# EasyEDA Pro project Q's HelloWorld KeyBoard.eprj, schematic SCH旋钮主控板
Create Date: 2022-10-09; Page Name: P1; Project Name: Q's HelloWorld KeyBoard; Schematic Name: SCH旋钮主控板; Update Date: 2022-10-15; Company: 嘉立创EDA; Page Size: A3; Version: V1.0
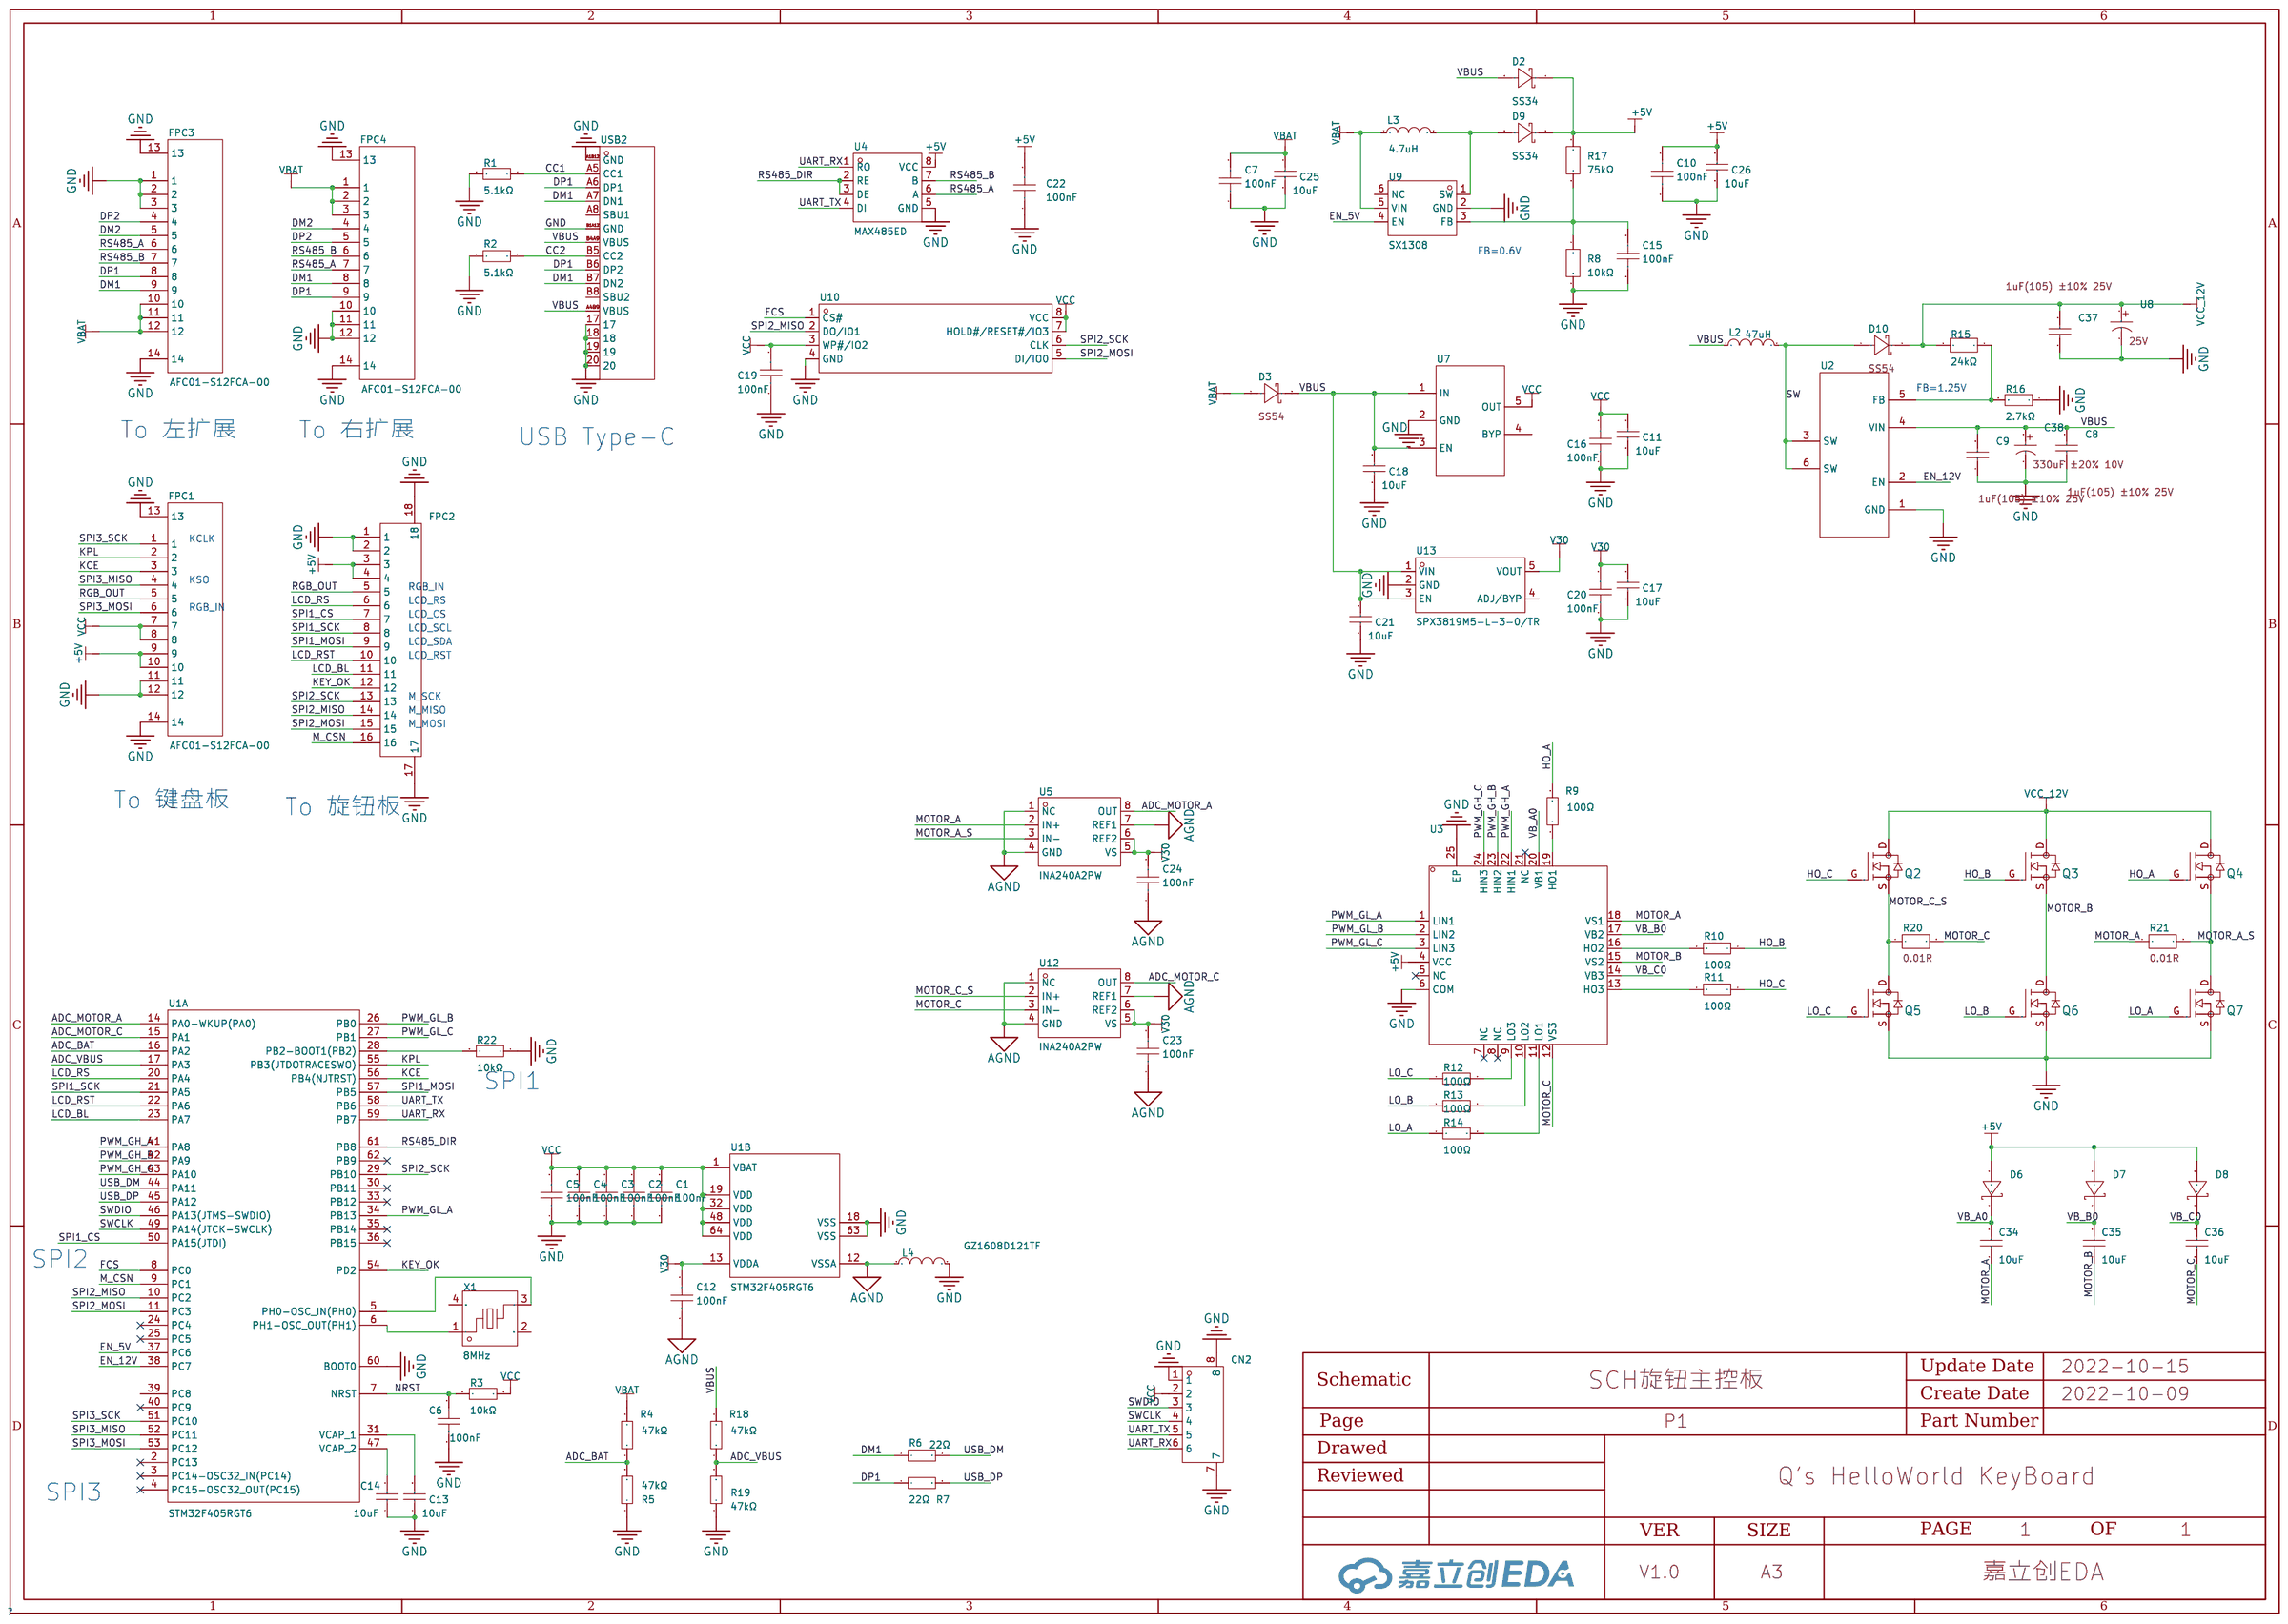
[diagram p8: schematic sheet]

## Parts
C1  100nF  [C0402]
C2  100nF  [C0402]
C3  100nF  [C0402]
C4  100nF  [C0402]
C5  100nF  [C0402]
C6  100nF  [C0402]
C7  100nF  [C0402]
C8  1uF  [C0402]
C9  1uF  [C0402]
C10  100nF  [C0402]
C11  10uF  [C0402]
C12  100nF  [C0402]
C13  10uF  [C0402]
C14  10uF  [C0402]
C15  100nF  [C0402]
C16  100nF  [C0402]
C17  10uF  [C0402]
C18  10uF  [C0402]
C19  100nF  [C0402]
C20  100nF  [C0402]
C21  10uF  [C0402]
C22  100nF  [C0402]
C23  100nF  [C0402]
C24  100nF  [C0402]
C25  10uF  [C0402]
C26  10uF  [C0402]
C34  10uF  [C0402]
C35  10uF  [C0402]
C36  10uF  [C0402]
C37  1uF  [C0402]
C38  330uF  [CAP-TH_BD6.3-P2.50-D1.0-FD]
CN2  1.0K-BH-6PWB  [CONN-SMD_6P-P1.00_HDGC_1.0K-BH-6PWB]
D2  SS34  [SMA_L4.3-W2.6-LS5.2-RD]
D3  SS54  [SMC_L7.1-W6.2-LS8.1-R-RD]
D6  -  [SOD-323_L1.8-W1.3-LS2.5-RD]
D7  -  [SOD-323_L1.8-W1.3-LS2.5-RD]
D8  -  [SOD-323_L1.8-W1.3-LS2.5-RD]
D9  SS34  [SMA_L4.3-W2.6-LS5.2-RD]
D10  SS54  [SMC_L7.1-W6.2-LS8.1-R-RD]
FPC1  AFC01-S12FCA-00  [FPC-SMD_AFC01-S12FCA-00]
FPC2  AFC01-S16FCA-00  [FPC-SMD_P0.50-16P_FGS-XJ-H2.0]
FPC3  AFC01-S12FCA-00  [FPC-SMD_AFC01-S12FCA-00]
FPC4  AFC01-S12FCA-00  [FPC-SMD_AFC01-S12FCA-00]
L2  47uH  [IND-SMD_L11.5-W10.0]
L3  4.7uH  [IND-SMD_L5.8-W5.2]
L4  GZ1608D121TF  [L0603]
Q2  EMB09N03V  [DFN3x3]
Q3  EMB09N03V  [DFN3x3]
Q4  EMB09N03V  [DFN3x3]
Q5  EMB09N03V  [DFN3x3]
Q6  EMB09N03V  [DFN3x3]
Q7  EMB09N03V  [DFN3x3]
R1  5.1kΩ  [R0402]
R2  5.1kΩ  [R0402]
R3  10kΩ  [R0402]
R4  47kΩ  [R0402]
R5  47kΩ  [R0402]
R6  22Ω  [R0402]
R7  22Ω  [R0402]
R8  10kΩ  [R0402]
R9  100Ω  [R0402]
R10  100Ω  [R0402]
R11  100Ω  [R0402]
R12  100Ω  [R0402]
R13  100Ω  [R0402]
R14  100Ω  [R0402]
R15  24kΩ  [R0402]
R16  2.7kΩ  [R0402]
R17  75kΩ  [R0402]
R18  47kΩ  [R0402]
R19  47kΩ  [R0402]
R20  ERJ14YJ205U  [R1210]
R21  ERJ14YJ205U  [R1210]
R22  10kΩ  [R0402]
U1  STM32F405RGT6  [LQFP-64_L10.0-W10.0-P0.50-LS12.0-BL]  (sections 1,2)
U2  -  [TO-263-5_L10.2-W9.9-P1.70-LS14.4-TL]
U3  -  [QFN-24_L4.0-W4.0-P0.50-BL-EP2.6]
U4  MAX485ED  [SOP-8_L4.9-W3.9-P1.27-LS6.0-BL]
U5  INA240A2PW  [TSSOP-8_L4.4-W3.0-P0.65-LS6.4-BR]
U7  -  [SOT-23-5_L3.0-W1.7-P0.95-LS2.8-BR]
U8  UHE1J471MHDFZXCV  [CAP-TH_BD12.5-P5.00-D0.6-FD]
U9  SX1308  [SOT-23-6_L2.9-W1.6-P0.95-LS2.8-BR]
U10  W25Q16JVSNIQ  [SOIC-8_L5.2-W5.2-P1.27-LS7.9-BL]
U12  INA240A2PW  [TSSOP-8_L4.4-W3.0-P0.65-LS6.4-BR]
U13  SPX3819M5-L-3-0/TR  [SOT-23-5_L2.9-W1.6-P0.95-LS2.8-TL]
USB2  TYPE-C-2.0-16PIN-SMT-3-OR  [USB-SMD_TYPE-C16PIN-1]
X1  8MHz  [OSC-SMD_4P-L3.2-W2.5-BL]

## Library data of the parts
C1-C7 C10 C12 C15 C16 C19 C20 C22-C24 = GCM155R71C104KA55J: 容值:100nF;精度:±10%;额定电压:-;材质(温度系数):-;; LCSC Part Name: 100nF ±10%; Supplier Part: C2655418; Manufacturer: muRata(村田); Supplier Footprint: 0402; JLCPCB Part Class: Extended Part; Datasheet: https://atta.szlcsc.com/upload/public/pdf/source/20210701/42090801FDE37D0E45AFF657247F4A08.pdf; Supplier: LCSC; Tolerance: ±10%
C8 C9 C37 = GRM155R61E105KA12D: 温度系数:X5R;额定电压:25V;精度:±10%;容值:1uF;; LCSC Part Name: 1uF(105) ±10% 25V; Supplier Part: C77009; Manufacturer: muRata(村田); Supplier Footprint: 0402; JLCPCB Part Class: Extended Part; Datasheet: https://atta.szlcsc.com/upload/public/pdf/source/20180326/C77009_C84F63FC30571BAC77C5C818267378FE.pdf; Supplier: LCSC; Temperature Coefficient: X5R; Voltage Rated: 25V; Tolerance: ±10%
C11 C13 C14 C17 C18 C21 C25 C26 = CL05A106MQ5NUNC: 容值:10uF;精度:±20%;额定电压:6.3V;材质(温度系数):X5R;; LCSC Part Name: 10uF ±20% 6.3V; Supplier Part: C15525; Manufacturer: SAMSUNG(三星); Supplier Footprint: 0402; JLCPCB Part Class: Basic Part; Datasheet: https://atta.szlcsc.com/upload/public/pdf/source/20220823/2B02EE04F8F211D38A52DCB16EB6BEBA.pdf; Supplier: LCSC; Tolerance: ±20%; Voltage Rated: 6.3V; Temperature Coefficient: X5R
C34-C36 = CC0402MRX5R5BB106: 容值:10uF;精度:±20%;额定电压:10V;温度系数:X5R;; LCSC Part Name: 10uF ±20% 10V; Supplier Part: C105884; Manufacturer: YAGEO(国巨); Supplier Footprint: 0402; Datasheet: https://atta.szlcsc.com/upload/public/pdf/source/20170728/C105884_1501225684064848716.pdf; Supplier: LCSC; Tolerance: ±20%; Voltage Rated: 10V; Temperature Coefficient: X5R
C38 = 10PX330MEFC6.3X11: 容值:330uF;精度:±20%;额定电压:10V;电容体直径:6.3mm;电容体长度:11mm;脚间距:2.5mm;纹波电流:282mA@10kHz;等效串联电阻:-;工作寿命:1000hrs@105;; LCSC Part Name: 330uF ±20% 10V; Supplier Part: C88841; Manufacturer: rubycon(红宝石); Supplier Footprint: 径向引线,6.3x11mm; JLCPCB Part Class: Extended Part; Datasheet: https://atta.szlcsc.com/upload/public/pdf/source/20161125/1480067908543.pdf; Supplier: LCSC; Tolerance: ±20%; Rated Voltage: 10V; φD: 6.3mm; L: 11mm; Lead Spacing: 2.5mm; Ripple Current: 282mA@10kHz; Lifetime @ Temp: 1000hrs@105
CN2 = 1.0K-BH-6PWB: 参考系列:-;间距:1mm;插针结构:1x6P;排数:1;每排PIN数:6;行距:-;公母:公型插针;安装方式:卧贴;额定电流:-;工作温度范围:-25~+85;; LCSC Part Name: 1x6P 间距P=1.0mm 卧贴 SMT; Supplier Part: C2919607; Manufacturer: HDGC(华德共创); Supplier Footprint: SMD,P=1mm; JLCPCB Part Class: Extended Part; Datasheet: https://atta.szlcsc.com/upload/public/pdf/source/20211115/0C4A9B301513FDEAA34F959002791CED.pdf; Supplier: LCSC; Pitch: 1mm; Pins Structure: 1x6P; Number of Rows: 1; Number of PINs Per Row: 6; Gender: 公型插针; Mounting Style: 卧贴; Operating Temperature Range: -25~+85
D2 D9 = SS34_C3032484: Supplier Part: C3032484; Manufacturer: TDD(台冠电子); Supplier Footprint: SMA; JLCPCB Part Class: Extended Part; Datasheet: https://atta.szlcsc.com/upload/public/pdf/source/20220622/9D70D0693761B542BF6F533590093AA5.pdf; Supplier: LCSC
D3 D10 = SS54_C211777: 二极管配置:独立式;直流反向耐压(Vr):40V;平均整流电流(Io):5A;正向压降(Vf):600mV@5A;反向电流(Ir):200A@40V;; LCSC Part Name: 40V 5A 600mV@5A; Supplier Part: C211777; Manufacturer: YANGJIE(扬杰); Supplier Footprint: SMC; JLCPCB Part Class: Extended Part; Datasheet: https://atta.szlcsc.com/upload/public/pdf/source/20200709/C698823_E961B659E8FF1C386B21C65769F2CB60.pdf; Supplier: LCSC; Diode Configuration: 独立式; Reverse Voltage (Vr): 40V; Average Rectified Current (Io): 5A; Forward Voltage (Vf@If): 600mV@5A; Reverse Leakage Current (Ir): 200A@40V
D6-D8 = B5819WS: 直流反向耐压(Vr):40V;平均整流电流(Io):1A;正向压降(Vf):900mV@3A;; LCSC Part Name: 40V 1A 900mV@3A; Supplier Part: C488405; Manufacturer: Slkor(萨科微); Supplier Footprint: SOD-323; Datasheet: https://atta.szlcsc.com/upload/public/pdf/source/20200225/C488405_E29BA61770FF7744B37A87F1ECFA4444.pdf; Supplier: LCSC; Reverse Voltage (Vr): 40V; Average Rectified Current (Io): 1A; Forward Voltage (Vf@If): 900mV@3A
FPC1 FPC3 FPC4 = AFC01-S12FCA-00: 间距:0.5mm;触点数量:12;锁定特性:翻盖式;安装类型:卧贴;触点类型:下接;; LCSC Part Name: 0.5mm P数:12 翻盖式 下接; Supplier Part: C262661; Manufacturer: JS(钜硕电子); Supplier Footprint: SMD,P=0.5mm; JLCPCB Part Class: Extended Part; Datasheet: https://atta.szlcsc.com/upload/public/pdf/source/20180810/C262661_216573474FA4FCB7E7D6D6C5859A7896.pdf; Supplier: LCSC; Pitch: 0.5mm; Number of Contacts: 12; Locking Feature: 翻盖式; Mounting Type: 卧贴; Contact Type: 下接; Height Above Board: 2mm; FFC, FCB Thickness: 0.3mm
FPC2 = AFC01-S16FCA-00: 间距:0.5mm;触点数量:16;锁定特性:翻盖式;安装类型:卧贴;触点类型:下接;; LCSC Part Name: 0.5mm P数:16 翻盖式 下接; Supplier Part: C262665; Manufacturer: JS(钜硕电子); Supplier Footprint: SMD,P=0.5mm; JLCPCB Part Class: Extended Part; Datasheet: https://atta.szlcsc.com/upload/public/pdf/source/20180814/C262665_DC336C287B4B4904E7F77F7A745F9142.pdf; Supplier: LCSC; Pitch: 0.5mm; Number of Contacts: 16; Locking Feature: 翻盖式; Mounting Type: 卧贴; Contact Type: 下接; Height Above Board: 2mm; FFC, FCB Thickness: 0.3mm
L2 = MS1040-330M: 电感值:33uH;精度:±20%;额定电流:3.5A;直流电阻(DCR):85mΩ;; LCSC Part Name: 33uH ±20% 3.5A 85mΩ; Supplier Part: C380056; Manufacturer: COILMX(迈翔科技); Supplier Footprint: SMD; JLCPCB Part Class: Extended Part; Datasheet: https://atta.szlcsc.com/upload/public/pdf/source/20190429/C380056_8E35FDD148AEC95757B8FF4D95CD7513.pdf; Supplier: LCSC; Tolerance: ±20%; Rated Current: 3.5A; DC Resistance (DCR): 85mΩ
L3 = CD54-4R7M-T-Z: 电感值:4.7uH;精度:±20%;额定电流:-;直流电阻(DCR):-;; LCSC Part Name: 4.7uH ±20%; Supplier Part: C501775; Manufacturer: Me-TECH(美台高科); Supplier Footprint: SMD; JLCPCB Part Class: Extended Part; Datasheet: https://atta.szlcsc.com/upload/public/pdf/source/20200324/C501728_0ED92A661C9AA91DB0CB8AF3A2A8117A.pdf; Supplier: LCSC; Tolerance: ±20%
L4 = GZ1608D121TF_C12391: 标称阻抗@测试频率:120Ω@100MHz;误差:±25%;直流电阻(RDC):200mΩ;额定电流:300mA;电路数:1;; LCSC Part Name: 120Ω@100MHz ±25%; Supplier Part: C12391; Manufacturer: Sunlord(顺络); Supplier Footprint: 0603; JLCPCB Part Class: Extended Part; Datasheet: https://atta.szlcsc.com/upload/public/pdf/source/20210830/355EA7C0FAC5394FC0FE3F17C770C20A.pdf; Supplier: LCSC; Impedance @ Frequency: 120Ω@100MHz; Tolerance: ±25%; DC Resistance: 200mΩ; Current Rating: 300mA; Circuits: 1
Q2-Q7 = EMB09N03V: MOSFET N-CH 30V 10A; Category: Discrete Semiconductor Products; Operating Temperature: -55°C ~ 175°C (TJ); Stock: 1490; FET Type: N-Channel; Manufacturer: ON Semiconductor; Manufacturer Part Number: NTMFS5C628NLT1G; Gate Charge (Qg) (Max) @ Vgs: 52nC @ 10V; Input Capacitance (Ciss) (Max) @ Vds: 3600pF @ 25V; Power Dissipation (Max): 3.7W (Ta), 110W (Tc); Rds On (Max) @ Id, Vgs: 2.4 mOhm @ 50A, 10V; Vgs (Max): ±20V; Vgs(th) (Max) @ Id: 2V @ 135µA; ComponentLink1Description: http://www.onsemi.com/pub/Collateral/NTMFS5C628NL-D.PDF; ComponentLink1URL: http://www.onsemi.com/pub/Collateral/NTMFS5C628NL-D.PDF; Drive Voltage (Max Rds On,  Min Rds On): 4.5V, 10V; Mounting Type: Surface Mount; Package / Case: 8-PowerTDFN; Packaging: Cut Tape (CT); Part Status: Active; Pricing 1: 1=1.8, 10=1.627, 100=1.3078, 500=1.01716 (USD); Pricing 2: 1500=0.81823 (USD); RoHS: RoHS Compliant; Supplier 1: Digi-Key; Supplier 2: Digi-Key; Supplier Device Package: 5-DFN (5x6) (8-SOFL); Supplier Part Number 1: NTMFS5C628NLT1GOSCT-ND; Supplier Part Number 2: NTMFS5C628NLT1GOSTR-ND; Technology: MOSFET (Metal Oxide)
R1 R2 = RMC04025.1K1%N: 阻值:5.1kΩ;精度:±1%;功率:62.5mW;; LCSC Part Name: 5.1kΩ ±1% 62.5mW; Supplier Part: C325521; Manufacturer: Tyohm(幸亚电阻); Supplier Footprint: 0402; JLCPCB Part Class: Extended Part; Datasheet: https://atta.szlcsc.com/upload/public/pdf/source/20190115/C325521_1EC5F156994D781C7E2B08432302F19F.pdf; Supplier: LCSC; Tolerance: ±1%; Power(Watts): 62.5mW
R3 R22 = AECR0402F10K0K9: 功率:0.063W;阻值:10kΩ;精度:±1%;; LCSC Part Name: 10KΩ(1002) ±1%; Supplier Part: C328298; Manufacturer: RESI(开步睿思）; Supplier Footprint: 0402; JLCPCB Part Class: Extended Part; Datasheet: https://atta.szlcsc.com/upload/public/pdf/source/20181108/C328298_2E8721712DFDC25EDA989FDD55A2877F.pdf; Supplier: LCSC; Power(Watts): 0.063W; Tolerance: ±1%
R4 R5 R18 R19 = RC-02W4702FT: 阻值:47kΩ;精度:±1%;功率:62.5mW;温度系数:±200ppm/;最大工作电压:50V;工作温度范围:-55~+155;; LCSC Part Name: 47kΩ ±1% 62.5mW; Supplier Part: C286560; Manufacturer: FH(风华); Supplier Footprint: 0402; JLCPCB Part Class: Extended Part; Datasheet: https://atta.szlcsc.com/upload/public/pdf/source/20180928/C286560_BD6B595325C950E64D46B3EA58FB4E6A.pdf; Supplier: LCSC; Tolerance: ±1%; Power(Watts): 62.5mW; Temperature Coefficient: ±200ppm/; Overload Voltage (Max): 50V; Operating Temperature Range: -55~+155
R6 R7 = RC0402FR-0722RL: 最大工作电压:50V;工作温度范围:-55~+155;电阻长:-;精度:±1%;电阻直径:-;电阻高:-;电阻宽:-;电阻类型:厚膜电阻;功率:62.5mW;温度系数:±100ppm/;阻值:22Ω;; LCSC Part Name: 22Ω ±1%; Supplier Part: C114765; Manufacturer: YAGEO(国巨); Supplier Footprint: 0402; JLCPCB Part Class: Extended Part; Datasheet: https://atta.szlcsc.com/upload/public/pdf/source/20170912/C114765_1505207820880963483.pdf; Supplier: LCSC; Overload Voltage (Max): 50V; Operating Temperature Range: -55~+155; Tolerance: ±1%; Type: 厚膜电阻; Power(Watts): 62.5mW; Temperature Coefficient: ±100ppm/
R8 R17 = CRCW0402100KJNED: 电阻类型:-;阻值:100kΩ;精度:±5%;功率:63mW;温度系数:±200ppm/K;最大工作电压:75V;工作温度范围:-55~+155;; LCSC Part Name: 100kΩ ±5%; Supplier Part: C482245; Manufacturer: VISHAY(威世); Supplier Footprint: 0402; JLCPCB Part Class: Extended Part; Datasheet: https://atta.szlcsc.com/upload/public/pdf/source/20200618/C481956_E25174B008CE8C884BEDD7D4D15E674F.pdf; Supplier: LCSC; Tolerance: ±5%; Power(Watts): 63mW; Temperature Coefficient: ±200ppm/K; Overload Voltage (Max): 75V; Operating Temperature Range: -55~+155
R9-R14 = RTT02101JTH: 电阻类型:厚膜电阻;阻值:100Ω;精度:±5%;功率:62.5mW;温度系数:±100ppm/;最大工作电压:50V;工作温度范围:-55~+155;; LCSC Part Name: 100Ω ±5% 62.5mW; Supplier Part: C102754; Manufacturer: RALEC(旺诠); Supplier Footprint: 0402; JLCPCB Part Class: Extended Part; Datasheet: https://atta.szlcsc.com/upload/public/pdf/source/20170408/1491642595227.pdf; Supplier: LCSC; Type: 厚膜电阻; Tolerance: ±5%; Power(Watts): 62.5mW; Temperature Coefficient: ±100ppm/; Overload Voltage (Max): 50V; Operating Temperature Range: -55~+155
R15 = ERJ2RKF2402X: 阻值:24kΩ;精度:±1%;功率:100mW;温度系数:±100ppm/;最大工作电压:-;工作温度范围:-55~+155;; LCSC Part Name: 24kΩ ±1%; Supplier Part: C409902; Manufacturer: PANASONIC(松下); Supplier Footprint: 0402; JLCPCB Part Class: Extended Part; Datasheet: https://atta.szlcsc.com/upload/public/pdf/source/20190806/C409902_ADCDB7CBE50354F36EEE3EF8885C5BA4.pdf; Supplier: LCSC; Tolerance: ±1%; Power(Watts): 100mW; Temperature Coefficient: ±100ppm/; Operating Temperature Range: -55~+155
R16 = 0402WGF2741TCE: 电阻类型:厚膜电阻;阻值:2.74kΩ;精度:±1%;功率:62.5mW;温度系数:±100ppm/;最大工作电压:50V;工作温度范围:-55~+155;; LCSC Part Name: 2.74kΩ ±1% 62.5mW; Supplier Part: C33360; Manufacturer: UNI-ROYAL(厚声); Supplier Footprint: 0402; JLCPCB Part Class: Extended Part; Datasheet: https://atta.szlcsc.com/upload/public/pdf/source/20200306/C422600_1E6D84923E4A46A82E41ADD87F860B5C.pdf; Supplier: LCSC; Type: 厚膜电阻; Tolerance: ±1%; Power(Watts): 62.5mW; Temperature Coefficient: ±100ppm/; Overload Voltage (Max): 50V; Operating Temperature Range: -55~+155
R20 R21 = ERJ14YJ205U: LCSC Part Name: 0.01R; Supplier Part: C713415; Manufacturer: PANASONIC(松下); Supplier Footprint: 1210; JLCPCB Part Class: Extended Part; Datasheet: https://atta.szlcsc.com/upload/public/pdf/source/20200731/C713415_1F1FD5AF118D6E20B390F0E6924F66A0.pdf; Supplier: LCSC
U1 = STM32F405RGT6: 主频（MAX):168MHz;工作电压:1.8V ~ 3.6V;; Supplier Part: C15742; Manufacturer: ST(意法半导体); Supplier Footprint: LQFP-64_10x10x05P; JLCPCB Part Class: Extended Part; Datasheet: https://atta.szlcsc.com/upload/public/pdf/source/20140724/1457707160365.pdf; Supplier: LCSC; Speed: 168MHz; Voltage - Supply (Vcc/Vdd): 1.8V ~ 3.6V; Program Memory Size: 1MB; RAM Size: 192KB; Number of I/O: 51; A/D: 16x12bit; D/A: 2x12bit; PWM: 56; LCD: MOTOROLA 6800 AND INTEL  8080 TYPE LCD DIRECTLY; UART/USART: 4 USART+2 UART; SPI: 3; I2C（SMBUS/PMBUS）: 3; USB Device: 1; USB Host/OTG: 1; CAN: 2
U2 = XL6019E1: 功能类型:升压型;同步整流:否;输出通道数:1;拓扑结构:升压式;输入电压:5V~40V;输出电压:60V;输出电流(最大值):5A;开关频率:220kHz;; LCSC Part Name: 升压型 5V~40V 5A 220kHz; Supplier Part: C73018; Manufacturer: XLSEMI(芯龙); Supplier Footprint: TO-263-5; JLCPCB Part Class: Extended Part; Datasheet: https://atta.szlcsc.com/upload/public/pdf/source/20160507/1462613618634.pdf; Supplier: LCSC; Function: 升压型; Synchronous Rectification: 否; Number of Outputs: 1; Topology: 升压式; Input Voltage: 5V~40V; Output Voltage: 60V; Output Current (Max): 5A; Switching Frequency: 220kHz
U3 = FD6288Q: Supplier Part: C328453; Manufacturer: Fortior Tech(峰岹); Supplier Footprint: QFN-24; JLCPCB Part Class: Extended Part; Datasheet: https://atta.szlcsc.com/upload/public/pdf/source/20181108/C328453_785547738DB9FC0123219FC22539EFAD.pdf; Supplier: LCSC
U4 = MAX485ED: 类型:-;协议类别:-;驱动器/接收器数:-;数据速率:-;; Supplier Part: C481667; Manufacturer: HTC; Supplier Footprint: SOP-8; JLCPCB Part Class: Extended Part; Datasheet: https://atta.szlcsc.com/upload/public/pdf/source/20200113/C481667_86CA12344B2034BBC3F3085D860BEB7C.pdf; Supplier: LCSC
U5 U12 = INA240A2PW: 具有增强的 PWM 抑制能力的 -4V 至 80V、双向、超精密电流感应放大器 8-TSSOP -40 to 125; Supplier Part: C1346461; Manufacturer: TI(德州仪器); Supplier Footprint: TSSOP-8; JLCPCB Part Class: Extended Part; Datasheet: https://atta.szlcsc.com/upload/public/pdf/source/20210607/AED5CCB0280C8C5A414BD6EEEB43F6C3.pdf; Supplier: LCSC
U7 = SPX3819M5-L-3-3/TR: 输出类型:固定;输出极性:正;输出通道数:1;最大输入电压:16V;输出电压:3.3V;压差:700mV@(500mA);输出电流:500mA;电源纹波抑制比(PRSS):70dB;; LCSC Part Name: Vin=16V Vout=3.3V 500mA 70dB; Supplier Part: C9055; Manufacturer: MaxLinear; Supplier Footprint: SOT-23-5; JLCPCB Part Class: 扩展库; Datasheet: https://atta.szlcsc.com/upload/public/pdf/source/20160421/1461205045150.pdf; Supplier: LCSC; Output Type: 固定; Output Polarity: 正; Number of Outputs: 1; Maximum Input Voltage: 16V; Output Voltage: 3.3V; Dropout Voltage: 700mV@(500mA); Output Current: 500mA; Power Supply Rejection Ratio (PRSS): 70dB
U8 = UHE1J471MHDFZXCV: 25V; LCSC Part Name: 电解电容; Supplier Part: C2757963; Manufacturer: Nichicon(尼吉康); Supplier Footprint: 12.5*25; JLCPCB Part Class: Extended Part; Supplier: LCSC
U9 = SX1308: 功能类型:升压型;同步整流:否;输出通道数:1;拓扑结构:升压式;输入电压:2V~24V;输出电压:28V;输出电流(最大值):-;开关频率:1.2MHz;; LCSC Part Name: 升压型 2V~24V 1.2MHz; Supplier Part: C78162; Manufacturer: SX(硕芯科技); Supplier Footprint: SOT-23-6; JLCPCB Part Class: Extended Part; Datasheet: https://atta.szlcsc.com/upload/public/pdf/source/20160920/1474356679185.pdf; Supplier: LCSC; Function: 升压型; Synchronous Rectification: 否; Number of Outputs: 1; Topology: 升压式; Input Voltage: 2V~24V; Output Voltage: 28V; Switching Frequency: 1.2MHz
U10 = W25Q16JVSNIQ_C2456211: Supplier Part: C2456211; Manufacturer: WINBOND(华邦); Supplier Footprint: SOIC-8; JLCPCB Part Class: Extended Part; Datasheet: https://atta.szlcsc.com/upload/public/pdf/source/20190529/C115407_78E5B4F96E7138D299EC51EC5982A1A5.pdf; Supplier: LCSC
U13 = SPX3819M5-L-3-0/TR: Supplier Part: C916171; Manufacturer: MaxLinear; Supplier Footprint: SOT-23-5; JLCPCB Part Class: Extended Part; Datasheet: https://atta.szlcsc.comnull; Supplier: LCSC
USB2 = TYPE-C-2.0-16PIN-SMT-3-OR: 连接器类型:Type-C;标准:USB 2.0;公母:母座;触点数量:16;端口数量:1;安装方式:卧贴;额定电流 - 电源:5A;工作温度范围:-30~+85;; LCSC Part Name: Type-C 母座 卧贴; Supplier Part: C2987387; Manufacturer: CIKI(皓富); Supplier Footprint: SMD; JLCPCB Part Class: Extended Part; Datasheet: https://atta.szlcsc.com/upload/public/pdf/source/20220407/C019AFF2D27CFCDD341E74F7831BCFEE.pdf; Supplier: LCSC; Connector Type: Type-C; Standard: USB 2.0; Gender: 母座; Number of Contacts: 16; Number of Ports: 1; Mounting Style: 卧贴; Current Rating - Power (Max): 5A; Operating Temperature Range: -30~+85
X1 = 3225-8.00-10-10-10/A: 晶振类型:贴片无源晶振;频率:8MHz;频率公差:±10ppm;频率稳定度:-;负载电容:10pF;工作温度:-;; LCSC Part Name: 8MHz ±10ppm 10pF; Supplier Part: C518154; Manufacturer: LIMING(利明); Supplier Footprint: SMD3225-4P; JLCPCB Part Class: Extended Part; Datasheet: https://atta.szlcsc.com/upload/public/pdf/source/20200603/C518143_C28693AFC6B5677A46756E3C75F63174.pdf; Supplier: LCSC; Crystal Type: 贴片无源晶振; Frequency Tolerance: ±10ppm; Load Capacitance: 10pF

## Nets
+5V: C10.2 C22.2 C26.2 D2.1(K) D6.2(A) D7.2(A) D8.2(A) D9.1(K) FPC1.9 FPC1.10 FPC2.3 FPC2.4 R17.1 U3.4(VCC) U4.8(VCC)
AGND: C12.1 C23.1 C24.1 L4.1 U1.12(VSSA) U5.1(NC) U5.4(GND) U5.7(REF1) U12.1(NC) U12.4(GND) U12.7(REF1)
GND: C1.1 C2.1 C3.1 C4.1 C5.1 C6.1 C7.1 C8.1 C9.1 C10.1 C11.1 C13.1 C14.1 C15.1 C16.1 C17.1 C18.1 C19.1 C20.1 C21.1 C22.1 C25.1 C26.1 C37.1 C38.2 CN2.1 CN2.7 CN2.8 FPC1.11 FPC1.12 FPC1.13 FPC1.14 FPC2.1 FPC2.2 FPC2.17 FPC2.18 FPC3.1 FPC3.2 FPC3.3 FPC3.13 FPC3.14 FPC4.10 FPC4.11 FPC4.12 FPC4.13 FPC4.14 L4.2 Q5.S Q6.S Q7.S R1.2 R2.1 R5.1 R8.2 R16.1 R19.1 R22.1 U1.18(VSS) U1.60(BOOT0) U1.63(VSS) U2.1(GND) U3.6(COM) U3.25(EP) U4.5(GND) U7.2(GND) U8.2 U9.2(GND) U10.4(GND) U13.2(GND) USB2.17 USB2.18 USB2.19 USB2.20 USB2.A1B12(GND) USB2.B1A12(GND)
V30: C12.2 C17.2 C20.2 C23.2 C24.2 U1.13(VDDA) U5.5(VS) U5.6(REF2) U12.5(VS) U12.6(REF2) U13.5(VOUT)
VBAT: C7.2 C25.2 D3.1(A) FPC3.10 FPC3.11 FPC3.12 FPC4.1 FPC4.2 FPC4.3 L3.1 R4.2 U9.5(VIN)
VBUS: C8.2 C9.2 C18.2 C21.2 C38.1 D2.2(A) D3.2(K) L2.1 R18.2 U2.4(VIN) U7.1(IN) U7.3(EN) U13.1(VIN) U13.3(EN) USB2.A4B9(VBUS) USB2.B4A9(VBUS)
VCC: C1.2 C2.2 C3.2 C4.2 C5.2 C11.2 C16.2 C19.2 CN2.2 FPC1.7 FPC1.8 R3.1 U1.1(VBAT) U1.19(VDD) U1.32(VDD) U1.48(VDD) U1.64(VDD) U7.5(OUT) U10.3(WP#/IO2) U10.7(HOLD#/RESET#/IO3) U10.8(VCC)
VCC_12V: C37.2 D10.2(K) Q2.D Q3.D Q4.D R15.2 U8.1
ADC_BAT: R4.1 R5.2 U1.16(PA2)
ADC_MOTOR_A: U1.14(PA0-WKUP(PA0)) U5.8(OUT)
ADC_MOTOR_C: U1.15(PA1) U12.8(OUT)
ADC_VBUS: R18.1 R19.2 U1.17(PA3)
CC1: R1.1 USB2.A5(CC1)
CC2: R2.2 USB2.B5(CC2)
DM1: FPC3.9 FPC4.8 R6.1 USB2.A7(DN1) USB2.B7(DN2)
DM2: FPC3.5 FPC4.4
DP1: FPC3.8 FPC4.9 R7.1 USB2.A6(DP1) USB2.B6(DP2)
DP2: FPC3.4 FPC4.5
EN_5V: U1.37(PC6) U9.4(EN)
EN_12V: U1.38(PC7) U2.2(EN)
FCS: U1.8(PC0) U10.1(CS#)
HO_A: Q4.G R9.2
HO_B: Q3.G R10.1
HO_C: Q2.G R11.1
KCE: FPC1.3 U1.56(PB4(NJTRST))
KEY_OK: FPC2.12 U1.54(PD2)
KPL: FPC1.2 U1.55(PB3(JTDOTRACESWO))
LCD_BL: FPC2.11 U1.23(PA7)
LCD_RS: FPC2.6 U1.20(PA4)
LCD_RST: FPC2.10 U1.22(PA6)
LO_A: Q7.G R14.1
LO_B: Q6.G R13.1
LO_C: Q5.G R12.1
M_CSN: FPC2.16 U1.9(PC1)
MOTOR_A: C34.1 R21.1 U3.18(VS1) U5.2(IN+)
MOTOR_A_S: Q4.S Q7.D R21.2 U5.3(IN-)
MOTOR_B: C35.1 Q3.S Q6.D U3.15(VS2)
MOTOR_C: C36.1 R20.2 U3.12(VS3) U12.3(IN-)
MOTOR_C_S: Q2.S Q5.D R20.1 U12.2(IN+)
NRST: C6.2 R3.2 U1.7(NRST)
PWM_GH_A: U1.41(PA8) U3.22(HIN1)
PWM_GH_B: U1.42(PA9) U3.23(HIN2)
PWM_GH_C: U1.43(PA10) U3.24(HIN3)
PWM_GL_A: U1.34(PB13) U3.1(LIN1)
PWM_GL_B: U1.26(PB0) U3.2(LIN2)
PWM_GL_C: U1.27(PB1) U3.3(LIN3)
RGB_OUT: FPC1.5 FPC2.5
RS485_A: FPC3.6 FPC4.7 U4.6(A)
RS485_B: FPC3.7 FPC4.6 U4.7(B)
RS485_DIR: U1.61(PB8) U4.2(RE) U4.3(DE)
SPI1_CS: FPC2.7 U1.50(PA15(JTDI))
SPI1_MOSI: FPC2.9 U1.57(PB5)
SPI1_SCK: FPC2.8 U1.21(PA5)
SPI2_MISO: FPC2.14 U1.10(PC2) U10.2(DO/IO1)
SPI2_MOSI: FPC2.15 U1.11(PC3) U10.5(DI/IO0)
SPI2_SCK: FPC2.13 U1.29(PB10) U10.6(CLK)
SPI3_MISO: FPC1.4 U1.52(PC11)
SPI3_MOSI: FPC1.6 U1.53(PC12)
SPI3_SCK: FPC1.1 U1.51(PC10)
SW: D10.1(A) L2.2 U2.3(SW) U2.6(SW)
SWCLK: CN2.4 U1.49(PA14(JTCK-SWCLK))
SWDIO: CN2.3 U1.46(PA13(JTMS-SWDIO))
UART_RX: CN2.6 U1.59(PB7) U4.1(RO)
UART_TX: CN2.5 U1.58(PB6) U4.4(DI)
USB_DM: R6.2 U1.44(PA11)
USB_DP: R7.2 U1.45(PA12)
VB_A0: C34.2 D6.1(K) U3.20(VB1)
VB_B0: C35.2 D7.1(K) U3.17(VB2)
VB_C0: C36.2 D8.1(K) U3.14(VB3)
$1N2101: U1.6(PH1-OSC_OUT(PH1)) X1.1
$1N2153: U1.5(PH0-OSC_IN(PH0)) X1.3
$1N3109: C14.2 U1.47(VCAP_2)
$1N3146: C13.2 U1.31(VCAP_1)
$1N6870: R9.1 U3.19(HO1)
$1N6871: R10.2 U3.16(HO2)
$1N6872: R11.2 U3.13(HO3)
$1N6885: R12.2 U3.9(LO3)
$1N6886: R13.2 U3.10(LO2)
$1N6887: R14.2 U3.11(LO1)
$1N14359: R15.1 R16.2 U2.5(FB)
$1N22382: D9.2(A) L3.2 U9.1(SW)
$1N23379: C15.2 R8.1 R17.2 U9.3(FB)
$1N80945: R22.2 U1.28(PB2-BOOT1(PB2))

Not connected (* = marked no-connect by the designer): U1 2(PC13)* 3(PC14-OSC32_IN(PC14))* 4(PC15-OSC32_OUT(PC15))* 24(PC4)* 25(PC5)* 30(PB11)* 33(PB12)* 35(PB14)* 36(PB15)* 39(PC8) 40(PC9)* 62(PB9)*; U3 5(NC)* 7(NC)* 8(NC)* 21(NC)*; U7 4(BYP); U9 6(NC); U13 4(ADJ/BYP); USB2 A8(SBU1) B8(SBU2); X1 2(GND) 4(GND)

## Notes on the sheet
- FB=0.6V
- FB=1.25V
- To 左扩展
- To 右扩展
- USB Type-C
- KCLK
- KSO
- RGB_IN
- RGB_IN
- LCD_RS
- LCD_CS
- LCD_SCL
- LCD_SDA
- LCD_RST
- M_SCK
- M_MISO
- M_MOSI
- To 键盘板
- To 旋钮板
- SPI1
- SPI2
- SPI3
